# EasyEDA Pro project 硬触发测试_2024-02-21_17-27-05(1).eprj, schematic Schematic1 (continued)
## Sheets (continued)
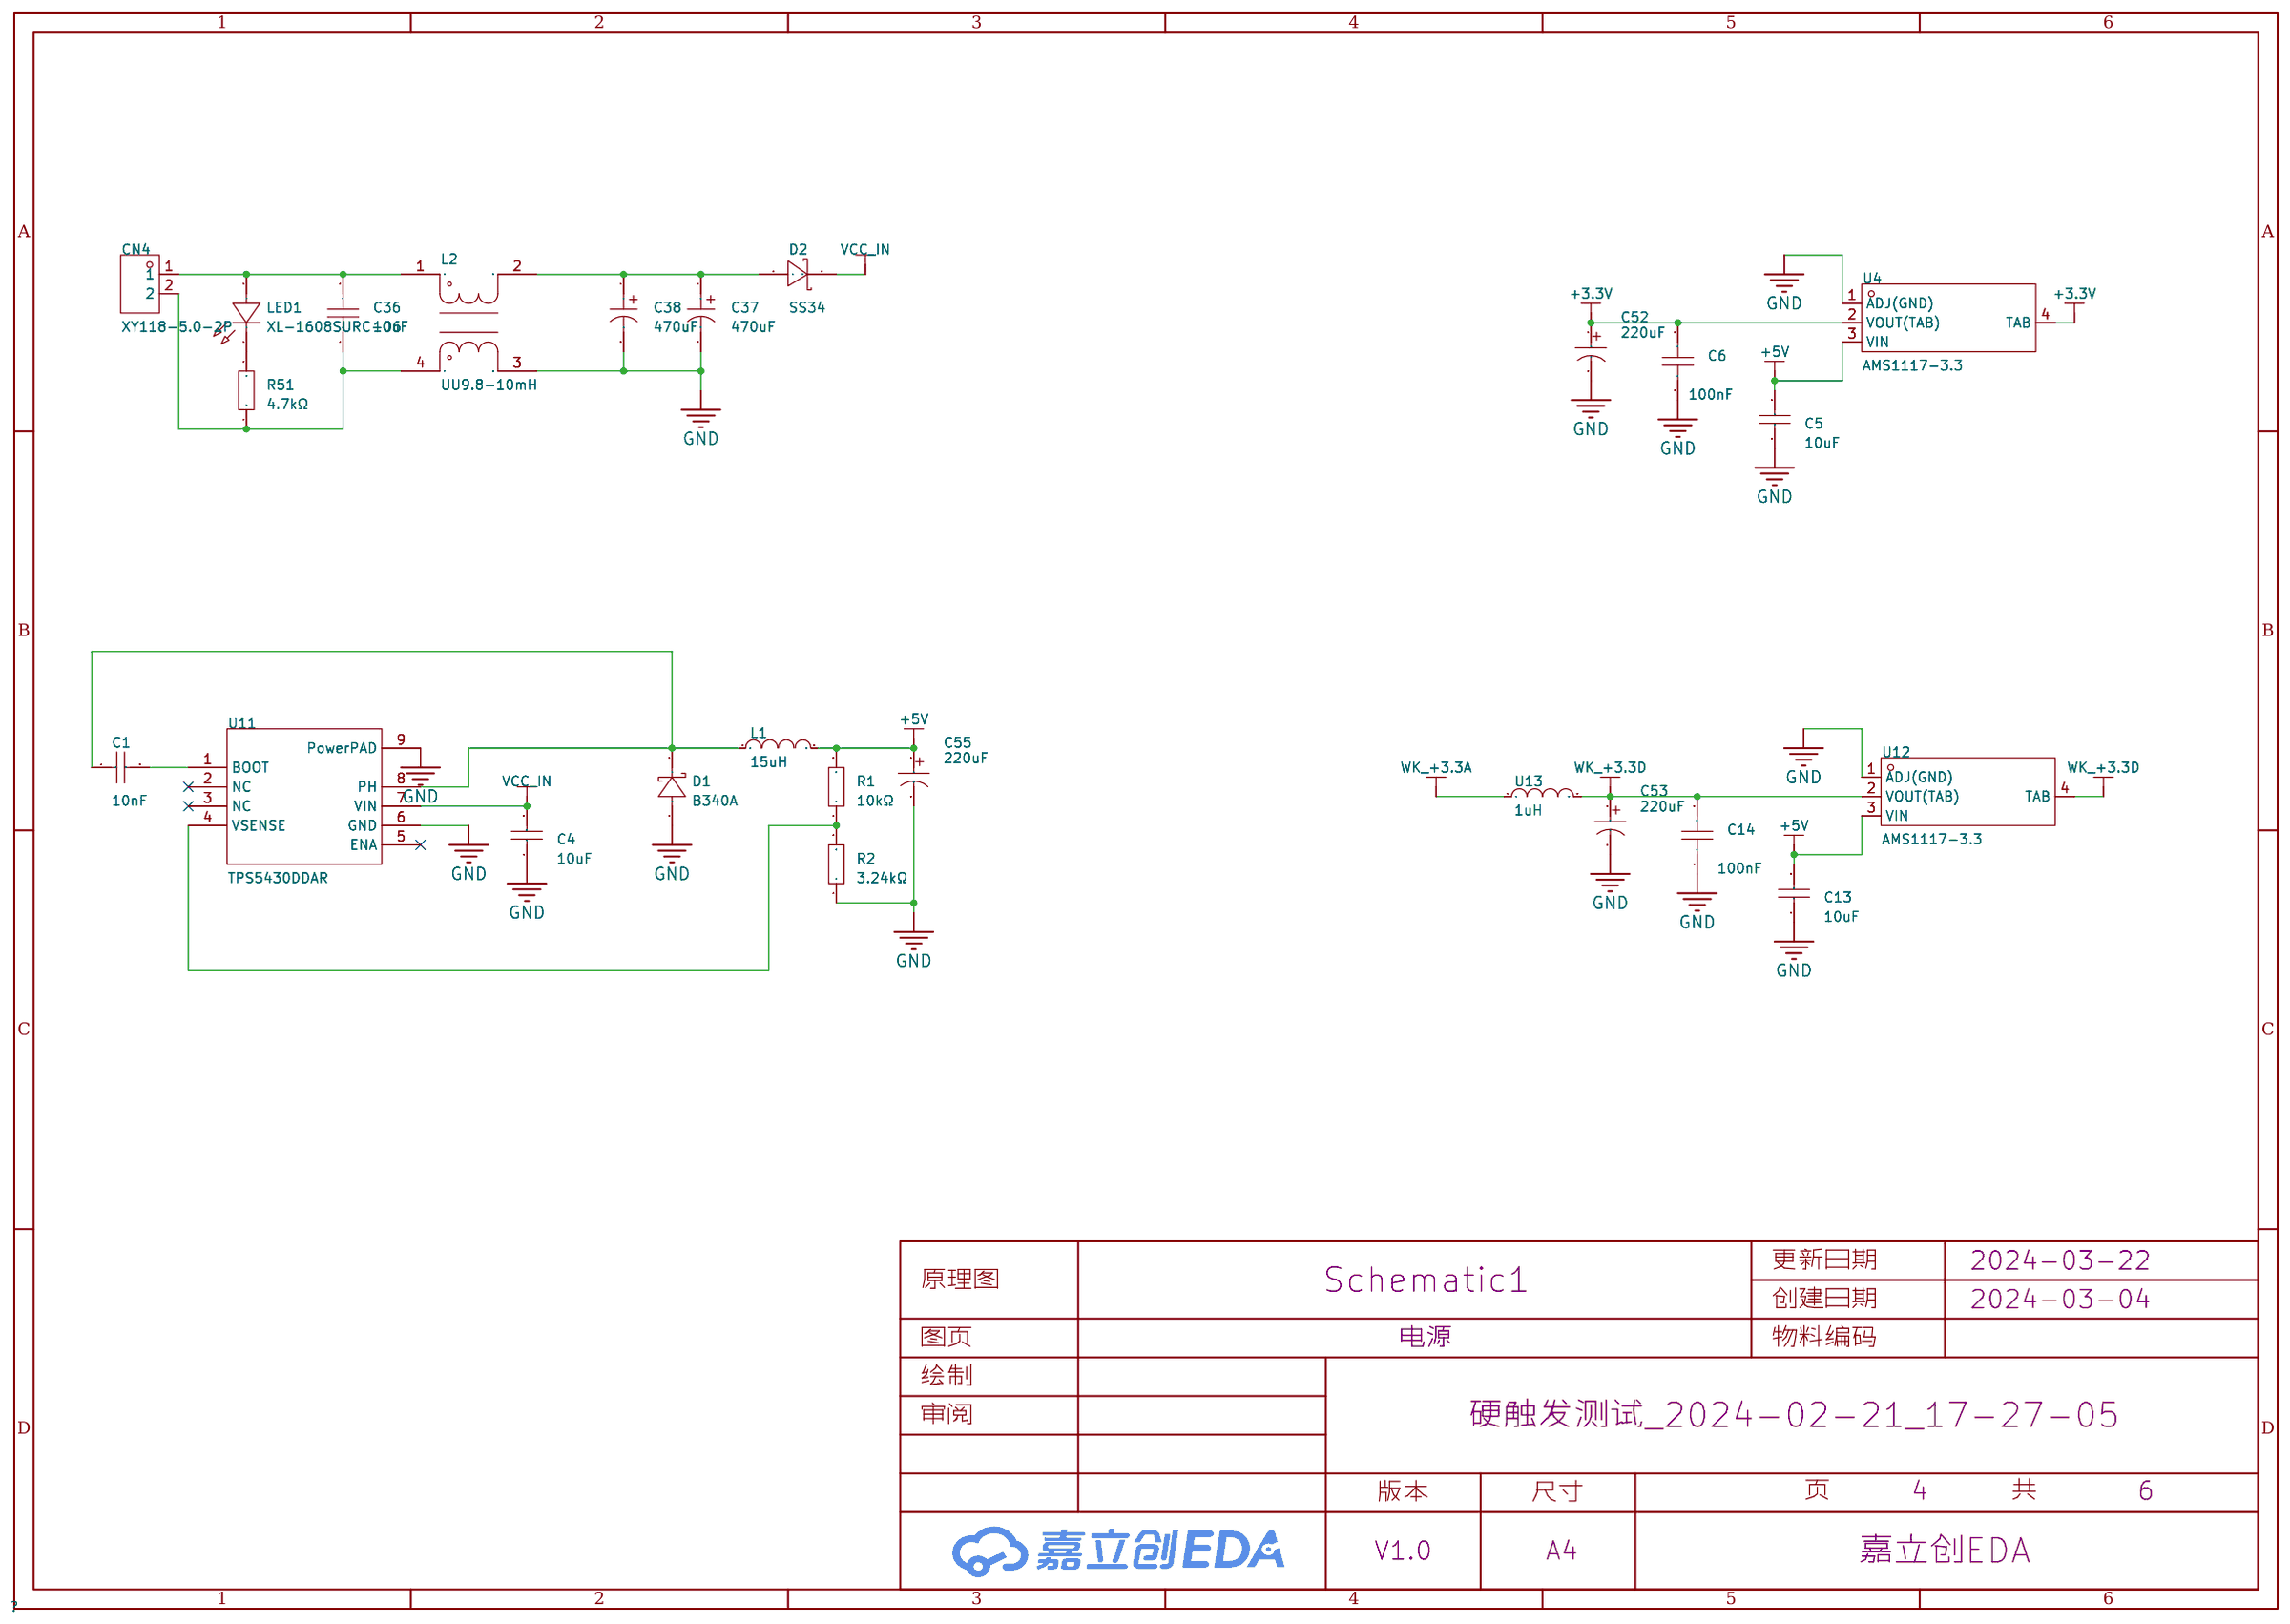
[diagram p3: 电源]
5 输入: Page Name: 输入; Update Date: 2024-03-04
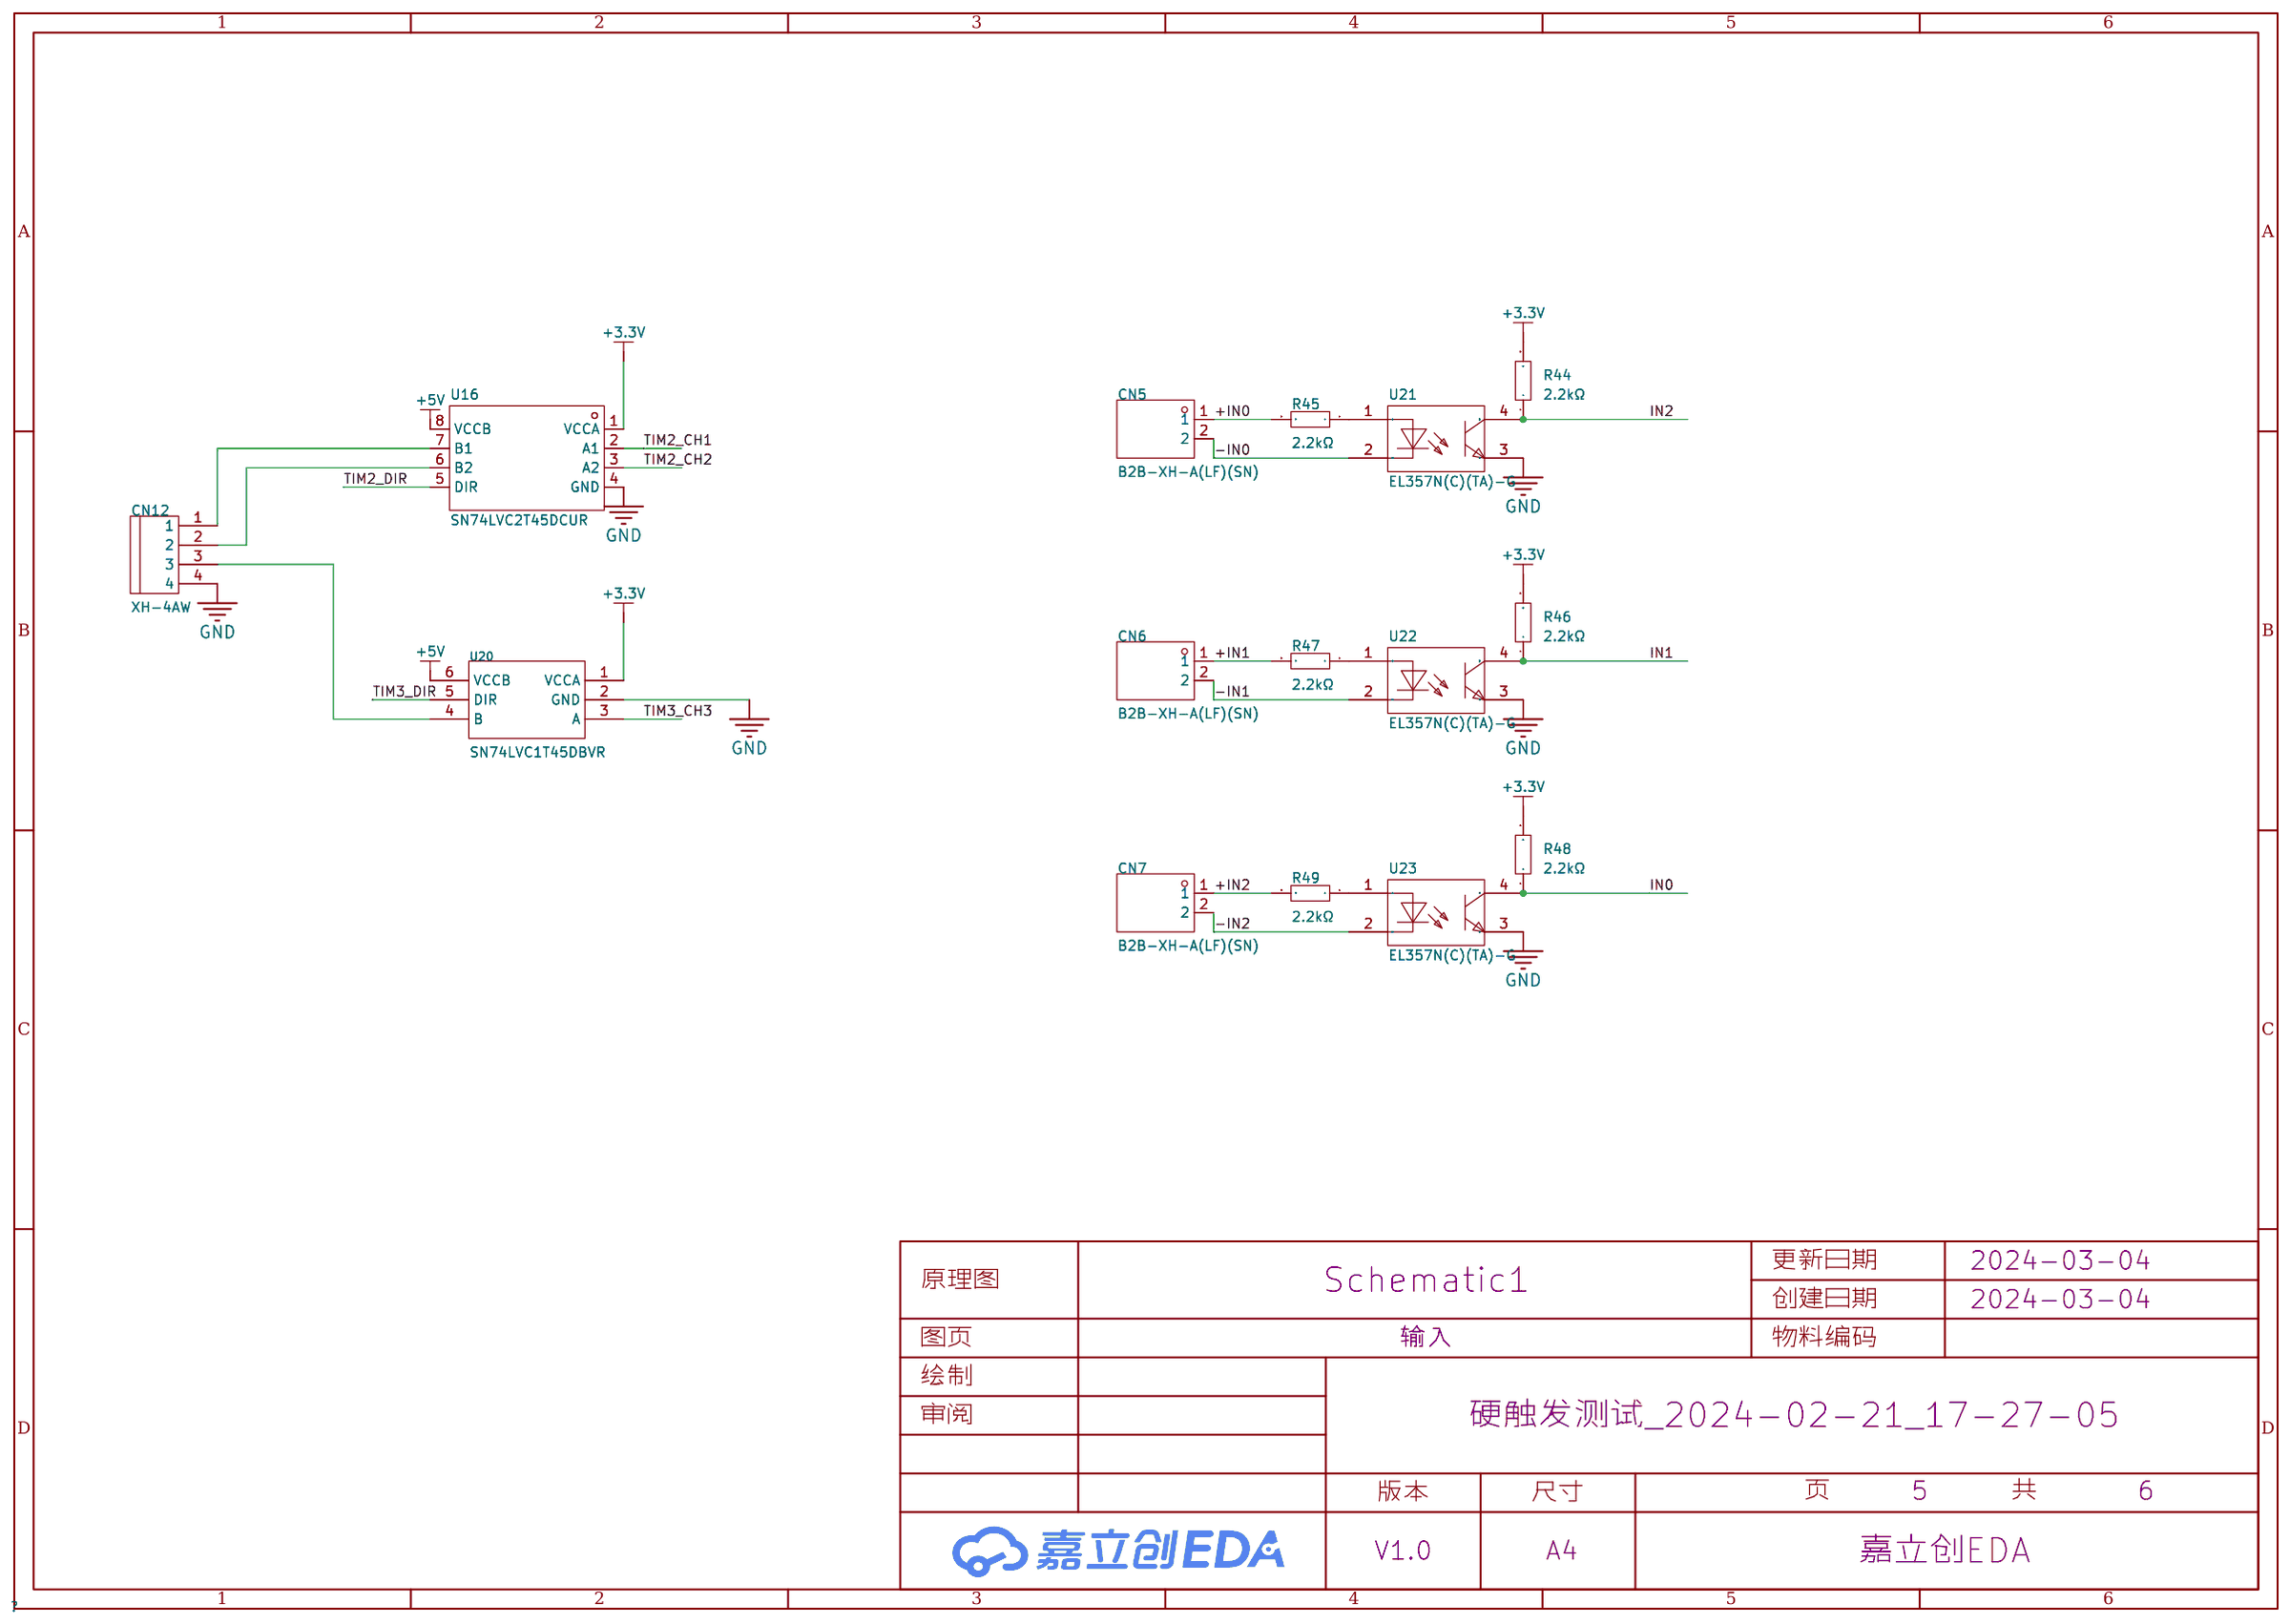
[diagram p4: 输入]
6 输出: Page Name: 输出; Update Date: 2024-03-04
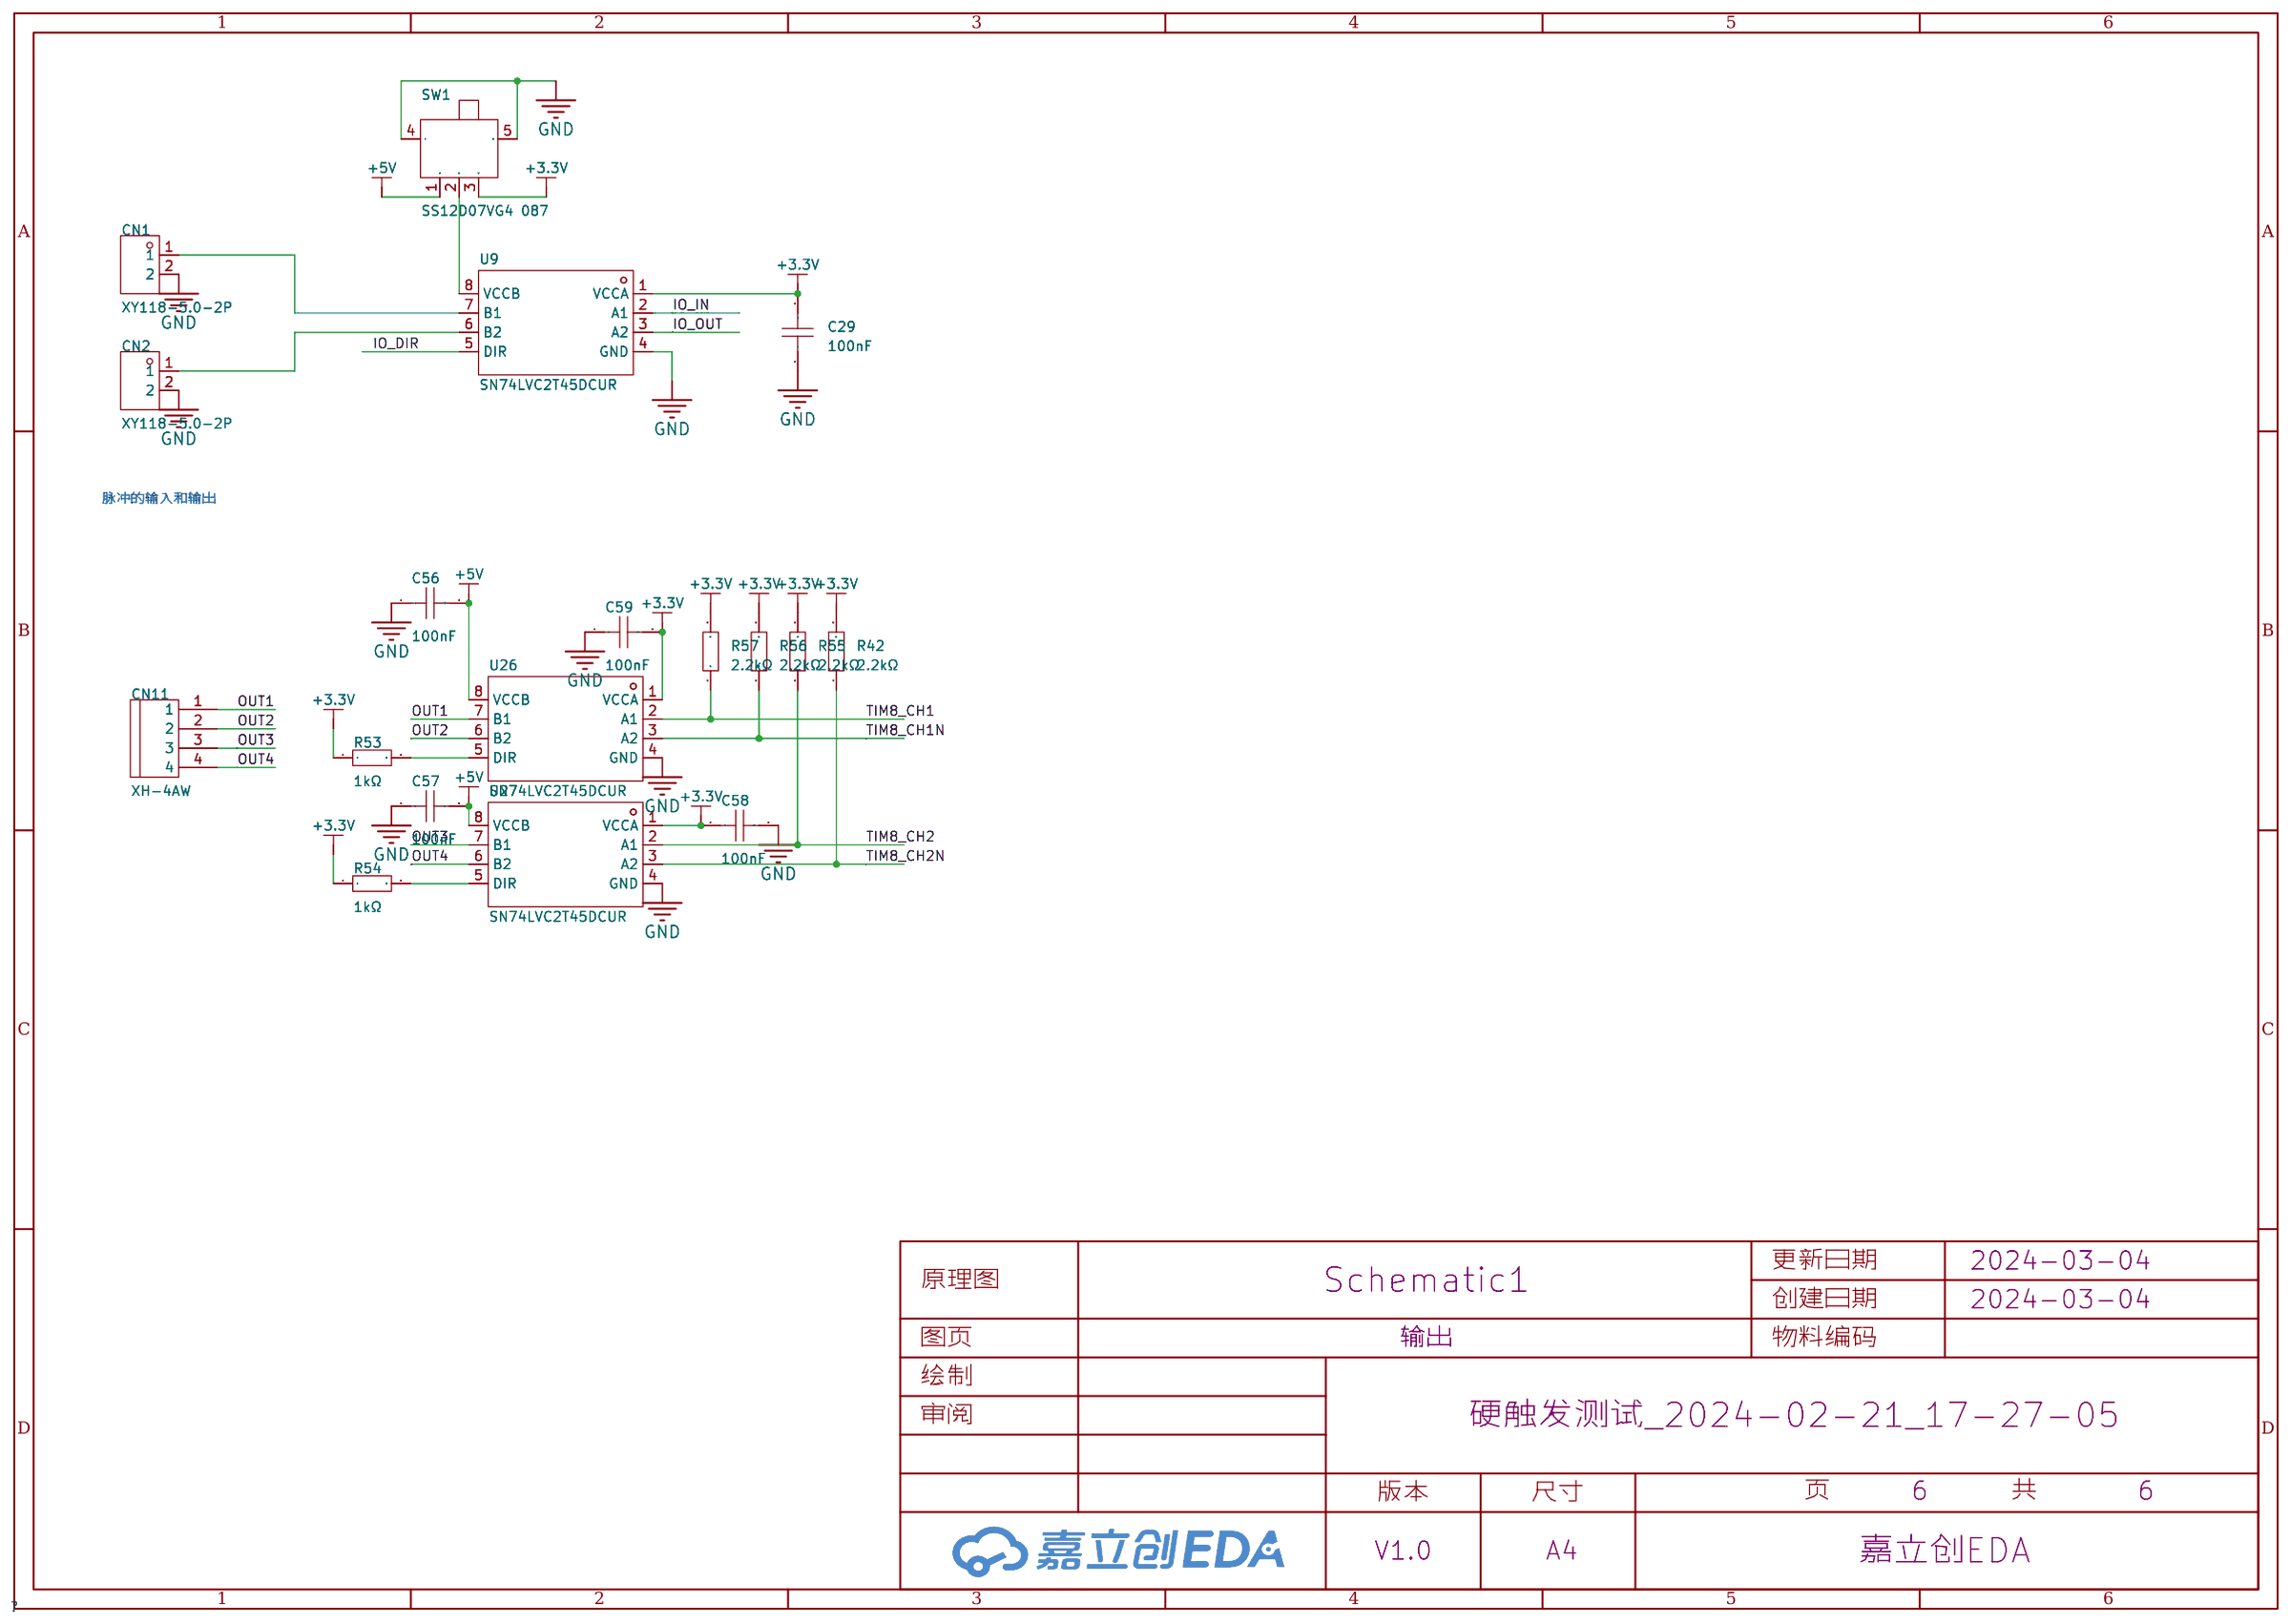
[diagram p5: 输出]

## Parts
sheet mcu
B1  BS-02-A1AJ010  [BAT-TH_BS-02-A1AJ010]
C8  100nF  [C0603]
C9  100nF  [C0603]
C10  100nF  [C0603]
C11  20pF  [C0603]
C12  20pF  [C0603]
C30  100nF  [C0603]
C40  100nF  [C0402]
C41  100nF  [C0402]
C42  100nF  [C0402]
C43  100nF  [C0402]
C45  2.2uF  [C0402]
C46  100nF  [C0402]
C54  100nF  [C0402]
C60  100nF  [C0603]
CN3  XH-4A  [CONN-TH_XH2.50-4P]
CN13  B2B-XH-A(LF)(SN)  [CONN-TH_B2B-XH-A-LF-SN]
H1  PZ254V-12-6P  [HDR-TH_6P-P2.54-V-M-R2-C3-S2.54]
L4  100uH  [L0805]
L5  100uH  [L0805]
LED2  XL-1608SURC-06  [LED0603-RD_RED]
P1  2.54-2*10P简牛  [IDC-TH_20P-P2.54-V-R2-C10-S2.54]
R3  4.7kΩ  [R0603]
R4  4.7kΩ  [R0603]
R5  4.7kΩ  [R0603]
R6  2.2kΩ  [R0603]
R7  2.2kΩ  [R0603]
R27  1MΩ  [R0603]
R35  10kΩ  [R0603]
R52  2.2kΩ  [R0603]
R58  4.7kΩ  [R0603]
R59  4.7kΩ  [R0603]
SW2  TS-1088-AR02016  [SW-SMD_L3.9-W3.0-P4.45]
U3  AT24C256C-SSHL-T  [SOIC-8_L4.9-W3.9-P1.27-LS6.0-BL]
U5  CH340N  [SOP-8_L4.9-W3.9-P1.27-LS6.0-BL]
U7  STM32F412RET6  [LQFP-64_L10.0-W10.0-P0.50-LS12.0-BL]
U10  DS1302ZM/TR  [SOP-8_L4.9-W3.9-P1.27-LS6.0-BL]
U24  100uF  [CAP-SMD_BD5.0-L5.3-W5.3-LS6.3-FD]
U28  SP3485EN-L/TR  [SOIC-8_L5.0-W4.0-P1.27-LS6.0-BL]
USB1  UX-144S-ACP5  [MINI-USB-SMD_UX-144S-ACP5]
X1  25MHz  [OSC-SMD_4P-L3.2-W2.5-BL]
X2  32.768kHz  [OSC-TH_BD2.0-P0.70-D0.3]
sheet usb
C31  12pF  [C0402]
C32  12pF  [C0402]
C33  100nF  [C0603]
C34  100nF  [C0603]
U14  CH374T  [SSOP-20_L7.5-W5.2-P0.65-LS8.0-BL]
U25  100uF  [CAP-SMD_BD5.0-L5.3-W5.3-LS6.3-FD]
USB2  USB-231-ARY  [USB-A-TH_USB-231-ARY]
X4  24MHz  [CRYSTAL-SMD_4P-L3.2-W2.5-BL]
sheet 电源
C1  10nF  [C0603]
C4  10uF  [C1206]
C5  10uF  [C1206]
C6  100nF  [C0603]
C13  10uF  [C1206]
C14  100nF  [C0603]
C36  10uF  [C0805]
C37  470uF  [CAP-SMD_BD10.0-L10.3-W10.3-LS11.0-FD]
C38  470uF  [CAP-SMD_BD10.0-L10.3-W10.3-LS11.0-FD]
C52  220uF  [CAP-SMD_BD6.3-L6.6-W6.6-FD]
C53  220uF  [CAP-SMD_BD6.3-L6.6-W6.6-FD]
C55  220uF  [CAP-SMD_BD6.3-L6.6-W6.6-FD]
CN4  XY118-5.0-2P  [CONN-TH_XY118-5.0-2P]
D1  B340A  [SMA_L4.3-W2.6-LS5.0-RD]
D2  SS34  [SMA_L4.3-W2.6-LS5.2-RD]
L1  15uH  [IND-SMD_L8.0-W8.0]
L2  UU9.8-10mH  [FILTER-TH_4P-L17.0-W12.0-P7.00-D0.6-S8.00]
LED1  XL-1608SURC-06  [LED0603-RD_RED]
R1  10kΩ  [R0603]
R2  3.24kΩ  [R0603]
R51  4.7kΩ  [R0603]
U4  AMS1117-3.3  [SOT-223-4_L6.5-W3.5-P2.30-LS7.0-BR]
U11  TPS5430DDAR  [ESOP-8_L4.9-W3.9-P1.27-LS6.0-TL-EP]
U12  AMS1117-3.3  [SOT-223-4_L6.5-W3.5-P2.30-LS7.0-BR]
U13  1uH  [L0603]
sheet 网口
C16  22nF  [C0603]
C17  100nF  [C0603]
C18  6.8nF  [C0603]
C19  6.8nF  [C0603]
C20  10nF  [C0603]
C21  100nF  [C0603]
C22  100nF  [C0603]
C23  4.7uF  [C0603]
C24  10nF  [C0603]
C27  18pF  [C0402]
C28  18pF  [C0402]
J1  HR911105A  [RJ45-TH_HR911105A]
R8  1kΩ  [R0603]
R9  1kΩ  [R0603]
R10  51Ω  [R0603]
R11  51Ω  [R0603]
R14  10Ω  [R0603]
R15  82Ω  [R0603]
R16  82Ω  [R0603]
R17  12.4kΩ  [R0603]
R18  10kΩ  [R0603]
R19  10kΩ  [R0603]
R20  10kΩ  [R0603]
R21  10kΩ  [R0603]
R22  10kΩ  [R0603]
R23  10kΩ  [R0603]
R24  10kΩ  [R0603]
R25  10kΩ  [R0603]
R26  10kΩ  [R0603]
R28  1MΩ  [R0603]
R29  10kΩ  [R0603]
R30  10kΩ  [R0603]
R31  10kΩ  [R0603]
R32  10kΩ  [R0603]
R33  10kΩ  [R0603]
R34  10kΩ  [R0603]
U2  W5500  [LQFP-48_L7.0-W7.0-P0.50-LS9.0-BL]
X3  25MHz  [OSC-SMD_4P-L3.2-W2.5-BL]
sheet 输入
CN5  B2B-XH-A(LF)(SN)  [CONN-TH_B2B-XH-A-LF-SN]
CN6  B2B-XH-A(LF)(SN)  [CONN-TH_B2B-XH-A-LF-SN]
CN7  B2B-XH-A(LF)(SN)  [CONN-TH_B2B-XH-A-LF-SN]
CN12  XH-4AW  [CONN-TH_XH2.54-4AW]
R44  2.2kΩ  [R0603]
R45  2.2kΩ  [R0603]
R46  2.2kΩ  [R0603]
R47  2.2kΩ  [R0603]
R48  2.2kΩ  [R0603]
R49  2.2kΩ  [R0603]
U16  SN74LVC2T45DCUR  [VSSOP-8_L2.4-W2.1-P0.50-LS3.2-BR]
U20  SN74LVC1T45DBVR  [SOT-23-6_L2.9-W1.6-P0.95-LS2.8-BR]
U21  EL357N(C)(TA)-G  [OPTO-SMD-4_L4.4-W4.1-P2.54-LS7.0-TL]
U22  EL357N(C)(TA)-G  [OPTO-SMD-4_L4.4-W4.1-P2.54-LS7.0-TL]
U23  EL357N(C)(TA)-G  [OPTO-SMD-4_L4.4-W4.1-P2.54-LS7.0-TL]
sheet 输出
C29  100nF  [C0603]
C56  100nF  [C0603]
C57  100nF  [C0603]
C58  100nF  [C0603]
C59  100nF  [C0603]
CN1  XY118-5.0-2P  [CONN-TH_XY118-5.0-2P]
CN2  XY118-5.0-2P  [CONN-TH_XY118-5.0-2P]
CN11  XH-4AW  [CONN-TH_XH2.54-4AW]
R42  2.2kΩ  [R0603]
R53  1kΩ  [R0603]
R54  1kΩ  [R0603]
R55  2.2kΩ  [R0603]
R56  2.2kΩ  [R0603]
R57  2.2kΩ  [R0603]
SW1  SS12D07VG4 087  [SW-TH_SS12D07VG4]
U9  SN74LVC2T45DCUR  [VSSOP-8_L2.4-W2.1-P0.50-LS3.2-BR]
U26  SN74LVC2T45DCUR  [VSSOP-8_L2.4-W2.1-P0.50-LS3.2-BR]
U27  SN74LVC2T45DCUR  [VSSOP-8_L2.4-W2.1-P0.50-LS3.2-BR]

## Library data of the parts
B1 = BS-02-A1AJ010: 连接器类型:电池底座;适用电池规格:CR2032;工作温度范围:-25℃~+85℃;; LCSC Part Name: 电池底座 适用电池:CR2032; Supplier Part: C5239862; Manufacturer: MYOUNG(美阳); Supplier Footprint: 插件; JLCPCB Part Class: 扩展库; Datasheet: https://atta.szlcsc.com/upload/public/pdf/source/20221102/8F00F2B23A2A3C447A59C327BBA6C743.pdf; Supplier: LCSC; Connector Type: 电池底座; Battery Type: CR2032; Operating Temperature Range: -25℃~+85℃
C6 C8-C10 C14 C17 C21 C22 C29 C30 C33 C34 C56-C59 = CC0603KRX7R9BB104: 容值:100nF;精度:±10%;额定电压:50V;材质(温度系数):X7R;; LCSC Part Name: 100nF ±10% 50V; Supplier Part: C14663; Manufacturer: YAGEO(国巨); Supplier Footprint: 0603; JLCPCB Part Class: 基础库; Datasheet: https://atta.szlcsc.com/upload/public/pdf/source/20180910/C282072_33301C7F631E79921B82A8DAC6BCC5B3.pdf; Supplier: LCSC; Tolerance: ±10%; Voltage Rated: 50V; Temperature Coefficient: X7R
C11 C12 = 0603CG200J500NT: 容值:20pF;精度:±5%;额定电压:50V;材质(温度系数):C0G;; LCSC Part Name: 20pF ±5% 50V; Supplier Part: C91702; Manufacturer: FH(风华); Supplier Footprint: 0603; JLCPCB Part Class: 扩展库; Datasheet: https://atta.szlcsc.com/upload/public/pdf/source/20200305/C486355_26A10D38EF8C2A5C37091D0039909270.pdf; Supplier: LCSC; Tolerance: ±5%; Voltage Rated: 50V; Temperature Coefficient: C0G
C40-C43 C46 C54 = CC0402KRX7R7BB104: 容值:100nF;精度:±10%;额定电压:16V;材质(温度系数):X7R;; LCSC Part Name: 100nF ±10% 16V; Supplier Part: C60474; Manufacturer: YAGEO(国巨); Supplier Footprint: 0402; JLCPCB Part Class: 扩展库; Datasheet: https://atta.szlcsc.com/upload/public/pdf/source/20211223/9278FD768280B81DDBEF48FA36411A03.pdf; Supplier: LCSC; Tolerance: ±10%; Voltage Rated: 16V; Temperature Coefficient: X7R
C45 = CL05A225MQ5NSNC: 容值:2.2uF;精度:±20%;额定电压:6.3V;材质(温度系数):X5R;; LCSC Part Name: 2.2uF ±20% 6.3V; Supplier Part: C12530; Manufacturer: SAMSUNG(三星); Supplier Footprint: 0402; JLCPCB Part Class: 基础库; Datasheet: https://atta.szlcsc.com/upload/public/pdf/source/20160218/1457707763339.pdf; Supplier: LCSC; Tolerance: ±20%; Voltage Rated: 6.3V; Temperature Coefficient: X5R
C60 = CC0603KRX7R9BB104: 容值:100nF;精度:±10%;额定电压:50V;材质(温度系数):X7R;; LCSC Part Name: 100nF ±10% 50V; Supplier Part: C14663; Manufacturer: YAGEO(国巨); Supplier Footprint: 0603; JLCPCB Part Class: Basic Part; Datasheet: https://atta.szlcsc.com/upload/public/pdf/source/20180910/C282072_33301C7F631E79921B82A8DAC6BCC5B3.pdf; Supplier: LCSC; Tolerance: ±10%; Voltage Rated: 50V; Temperature Coefficient: X7R
CN3 = XH-4A_C2908602: 插针结构:1x4P;间距:2.5mm;安装方式:直插;参考系列:XH;总PIN数:4P;排数:1;每排PIN数:4;行距:-;额定电流:3A;触头材质:黄铜;触头镀层:锡;工作温度范围:-25℃~+85℃;; LCSC Part Name: 1x4P 间距:2.5mm 直插 系列:XH; Supplier Part: C2908602; Manufacturer: HCTL(华灿天禄); Supplier Footprint: 插件,P=2.5mm; JLCPCB Part Class: 扩展库; Datasheet: https://atta.szlcsc.com/upload/public/pdf/source/20230711/68D365716984B4AFE576D1D73D61B465.pdf; Supplier: LCSC; Pins Structure: 1x4P; Pitch: 2.5mm; Mounting Style: 直插; Reference Series: XH; Number of Pins: 4P; Number of Rows: 1; Number of PINs Per Row: 4; Current Rating (Max): 3A; Contact Material: 黄铜; Contact Plating: 锡; Operating Temperature Range: -25℃~+85℃
CN5-CN7 CN13 = B2B-XH-A(LF)(SN): 插针结构:1x2P;间距:2.5mm;安装方式:-;参考系列:XH;总PIN数:2P;排数:1;每排PIN数:2;行距:-;触头材质:黄铜;; LCSC Part Name: 系列:XH 间距:2.5mm 1x2P; Supplier Part: C158012; Manufacturer: JST; Supplier Footprint: 插件,P=2.5mm; JLCPCB Part Class: 扩展库; Datasheet: https://atta.szlcsc.com/upload/public/pdf/source/20180928/C265283_F9DFEEBDB2CF642B6BDFAB4B77BD2680.pdf; Supplier: LCSC; Pins Structure: 1x2P; Pitch: 2.5mm; Reference Series: XH; Number of Pins: 2P; Number of Rows: 1; Number of PINs Per Row: 2; Contact Material: 黄铜
H1 = PZ254V-12-6P: 插针结构:2x3P;间距:2.54mm;行距:2.54mm;圆针/方针:方针;安装类型:直插;排数:双排;总PIN位数:6P;额定电流:-;额定电压:-;配合针长度:6mm;塑高:2.5mm;端接针长度:3mm;触头材质:黄铜;触头镀层:-;工作温度范围:-40℃~+105℃;颜色:黑色;; LCSC Part Name: 间距:2.54mm 2x3P 直插 方针; Supplier Part: C492420; Manufacturer: XFCN(兴飞); Supplier Footprint: 插件,P=2.54mm; JLCPCB Part Class: 扩展库; Datasheet: https://atta.szlcsc.com/upload/public/pdf/source/20200309/C492420_BAECB307B001054C09D200388220EAE6.pdf; Supplier: LCSC; Pin Structure: 2x3P; Pitch: 2.54mm; Row Spacing: 2.54mm; Circluar Pins/Square Pins: 方针; Mounting Type: 直插; Number of Rows: 双排; Number of Pins: 6P; Length of Mating Pin: 6mm; Insulation Height: 2.5mm; Length of End Connection Pin: 3mm; Contact Material: 黄铜; Operating Temperature Range: -40℃~+105℃; Color: 黑色
L4 L5 = MLF2012C101KT000: 电感值:100uH;精度:±10%;额定电流:2mA;饱和电流(Isat):-;直流电阻(DCR):2.5Ω;; LCSC Part Name: 100uH ±10%; Supplier Part: C68035; Manufacturer: TDK; Supplier Footprint: 0805; JLCPCB Part Class: 扩展库; Datasheet: https://atta.szlcsc.com/upload/public/pdf/source/20160817/1471407089654.pdf; Supplier: LCSC; Tolerance: ±10%; Rated Current: 2mA; DC Resistance (DCR): 2.5Ω; Q @ Freq: 25@1MHz; Frequency - Self Resonant: 7MHz
LED1 LED2 = XL-1608SURC-06: 发光颜色:红色;功率:55mW;正向电流:25mA;主波长:617nm~621nm;透镜颜色:无色透明透镜;色温:-;发光角度:120°;载带方式:正贴;工作温度:-30℃~+85℃;; Supplier Part: C965799; Manufacturer: XINGLIGHT(成兴光); Supplier Footprint: 0603; JLCPCB Part Class: 扩展库; Datasheet: https://atta.szlcsc.com/upload/public/pdf/source/20221102/D860AFDD1CDB02C5A8064103A32707E2.pdf; Supplier: LCSC; Emitted Color: 红色; Power Dissipation: 55mW; Forward Current: 25mA; Dominant Wavelength: 617nm~621nm; Peak Wavelength: 623nm; Lens Color: 无色透明透镜; Viewing Angle: 120°; Mounting Sytle: 正贴; Operating Temperature: -30℃~+85℃